# EasyEDA Pro project ProPrj_Avaota A1 八核 AIoT 开发板_2024-05-03.epro, board 点位_BOTTOM (continued)
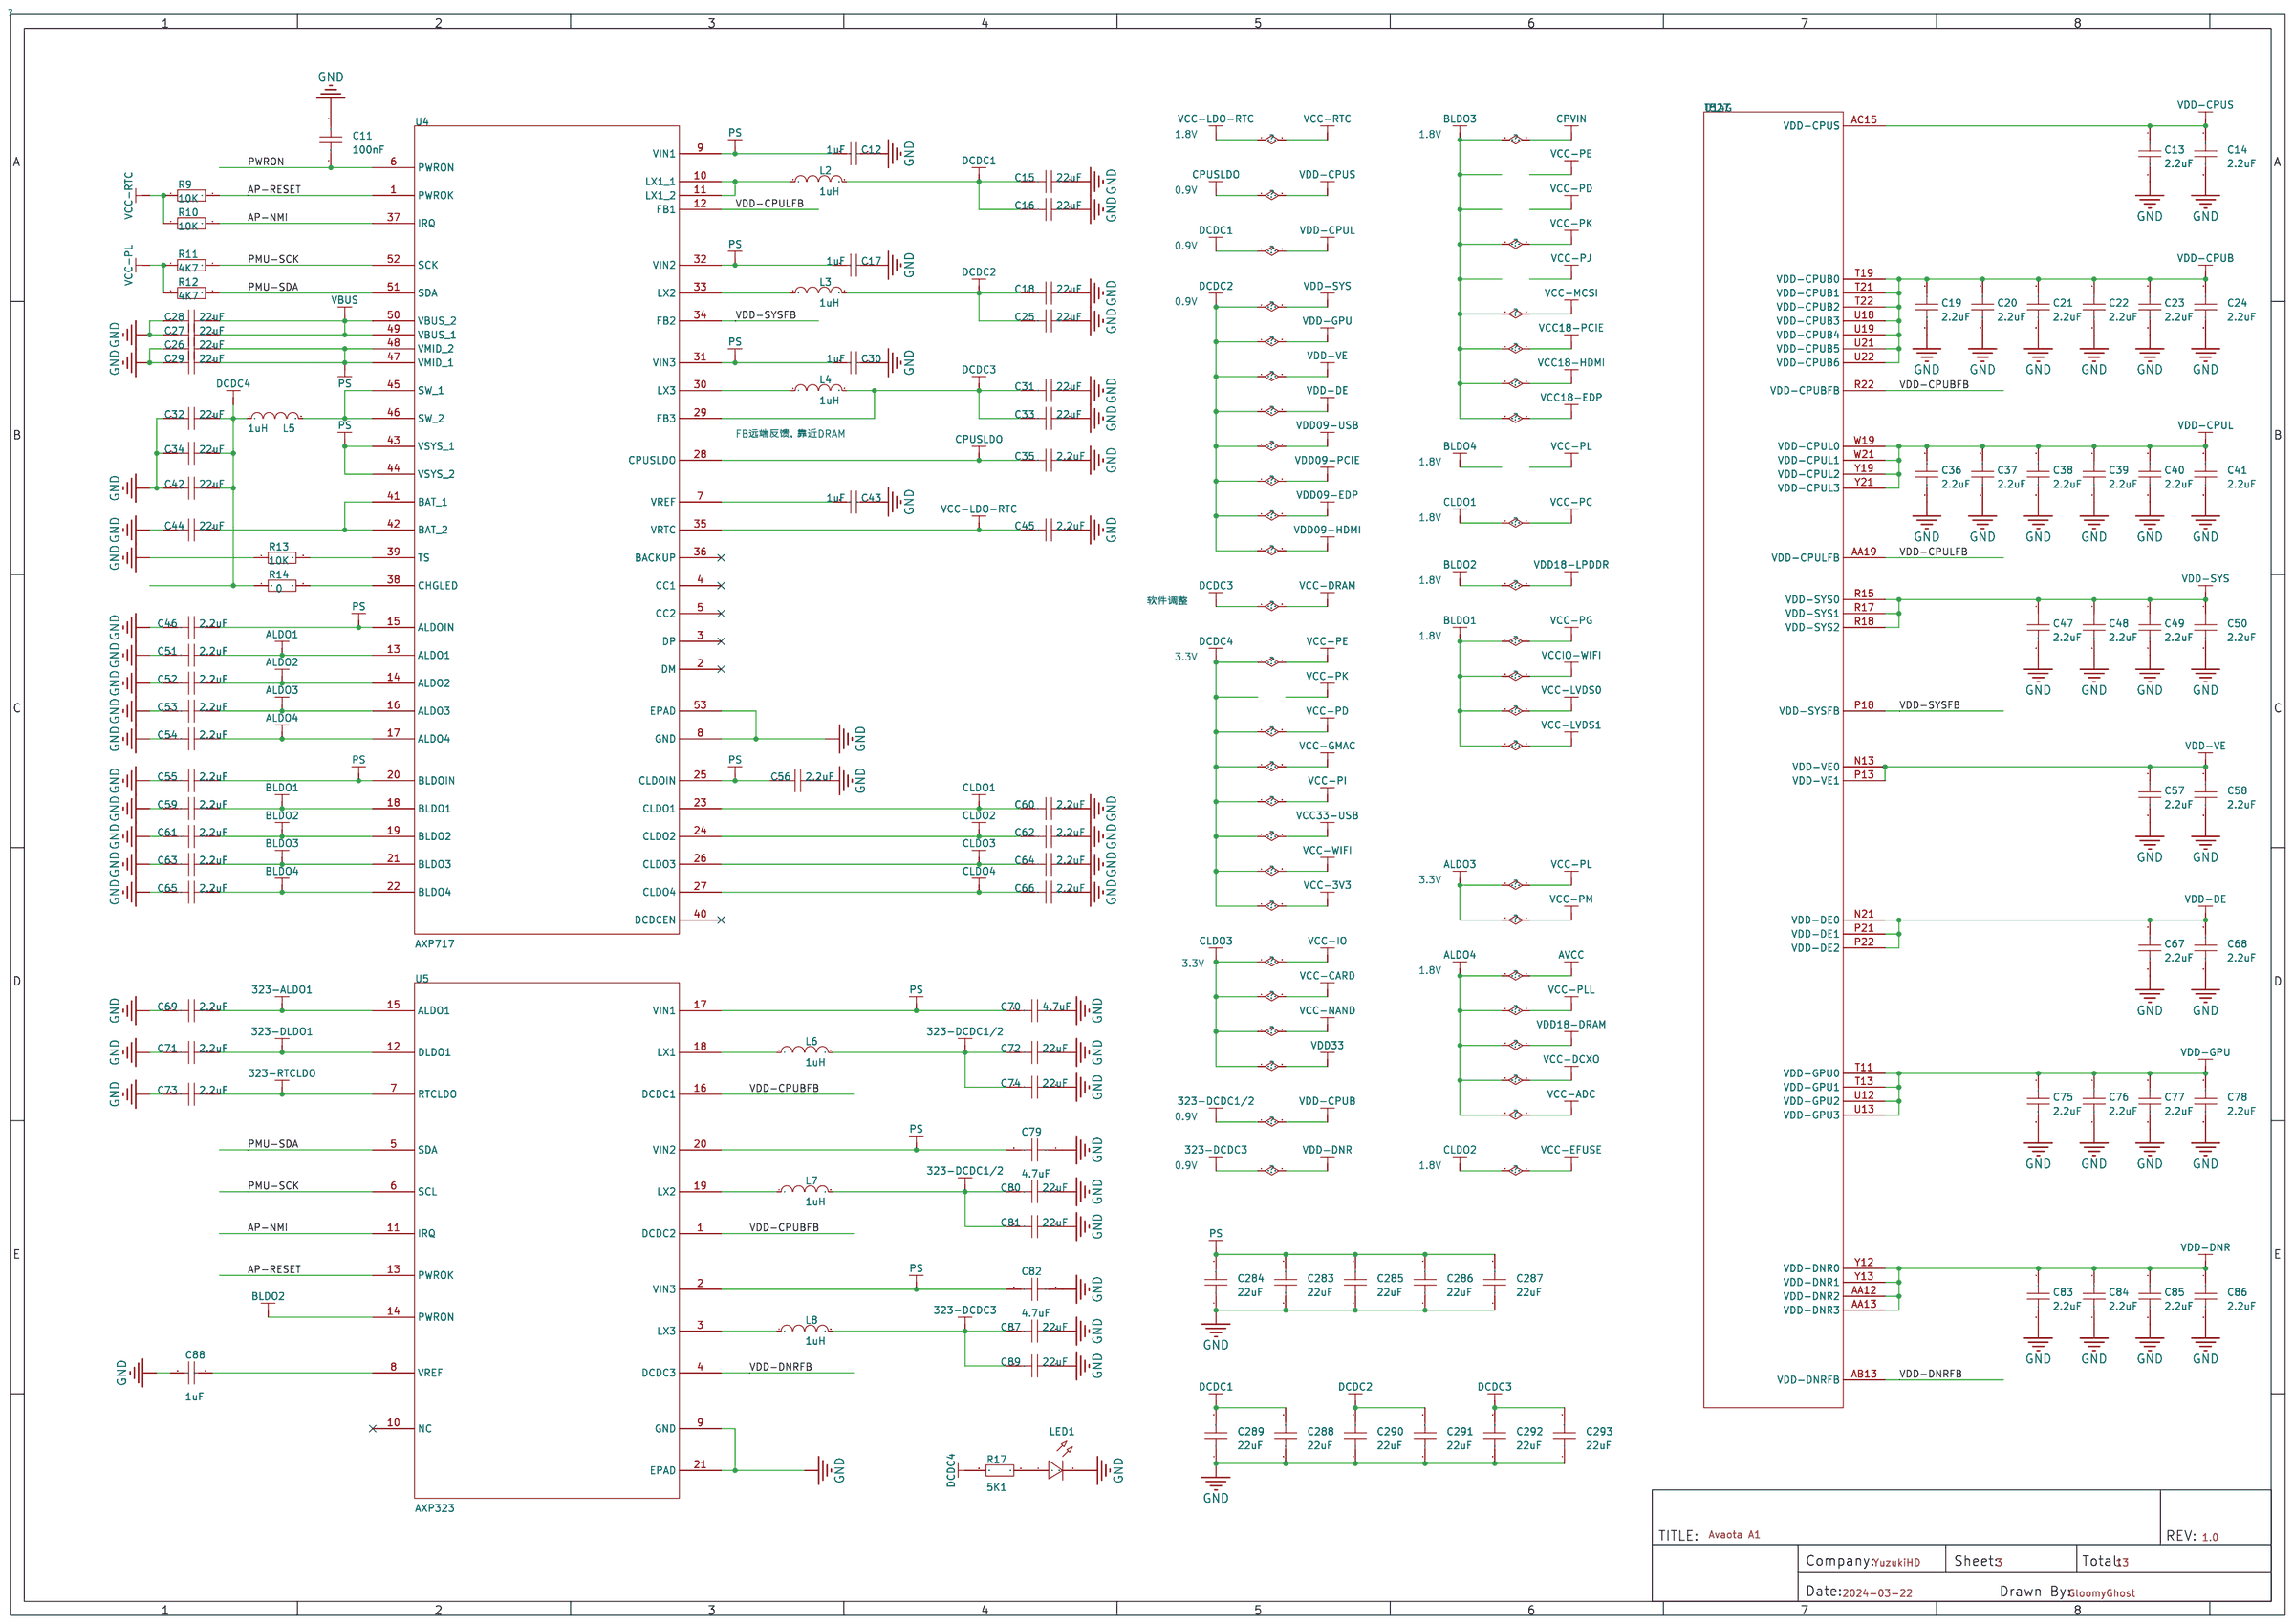
[diagram p0: POWER]
## Routing (per net, layer and track width the routed paths; a pad name or vN(x,y) marks a point on that pad's centre or on a via; arc(x,y) is an arc through that point) (continued)
  Bottom Layer w0.127: C238.1 70.48,67.75 70.3,67.57 70.3,66.88 70.64,66.55 70.64,64.55 68.65,62.56 67.92,62.56 v1(66.12,60.76)
PE0: length 57.3
  Inner5 w0.102: 20.6,73.23 21.89,71.93 21.89,69.82 23.29,68.43 26.11,68.43 27.86,66.68 53.06,66.68 57.71,62.03 59.61,62.03 63.93,57.71 63.93,57.1 65.53,55.5 67.11,55.5 67.29,55.31 67.29,54.6 67.74,54.15 v2(67.94,54.15)
PE1: length 45
  VCC w0.102: v2(72.67,57.2) 72.29,57.58 71.22,57.58 71.12,57.48 67.18,57.48 66.19,58.47 64.8,58.47 61.29,61.98 57.05,61.98 52.5,66.52 37.49,66.52 33.32,70.69 33.3,70.69
PE2: length 52.2
  Inner5 w0.102: 23.14,70.69 25.04,68.78 26.24,68.78 27.99,67.03 53.26,67.03 57.94,62.36 59.77,62.36 64.26,57.86 64.26,57.25 65.68,55.83 67.23,55.83 67.59,55.47 67.59,54.87 67.78,54.68 67.93,54.68 v2(67.95,54.65)
PE3: length 54.4
  Inner5 w0.102: v2(67.95,55.15) 67.95,55.65 67.44,56.16 65.76,56.16 64.59,57.33 64.59,58.12 60.02,62.69 58.14,62.69 53.47,67.36 28.19,67.36 26.39,69.16 25.04,69.16 24.46,69.75 24.46,72.16 24.88,72.58 25.03,72.58 25.68,73.23
PE4: length 51.8
  Inner5 w0.102: 25.68,70.69 25.68,70.46 28.45,67.69 53.64,67.69 57.53,63.81 59.51,63.81 65.71,57.61 70.51,57.61 v2(71.5,58.6)
PE5: length 48.7
  VCC w0.102: 33.3,73.23 33.3,73.15 32.03,71.88 32.03,69.98 35.81,66.19 52.3,66.19 56.85,61.65 61.11,61.65 64.62,58.14 66.01,58.14 67.01,57.15 71.53,57.15 v2(71.58,57.2)
PE6: length 47.3
  VCC w0.102: 30.76,70.69 30.76,70.64 35.53,65.86 52.17,65.86 56.77,61.27 60.96,61.27 64.36,57.86 65.84,57.86 66.88,56.82 71.81,56.82 72.14,57.15 v2(72.14,57.2)
PE7: length 47.4
  VCC w0.102: v2(72.62,58.62) 72.62,58.34 72.11,57.84 71.07,57.84 71.02,57.79 67.36,57.79 66.37,58.78 65,58.78 61.47,62.31 57.2,62.31 52.65,66.85 37.69,66.85 34.62,69.93 34.62,72.03 35.81,73.23 35.84,73.23
PE8: length 41.9
  VCC w0.102: v2(72.06,58.6) 71.55,58.09 67.49,58.09 66.5,59.08 65.2,59.08 61.59,62.69 57.38,62.69 52.81,67.26 38.81,67.26 35.84,70.23 35.84,70.69
PE9: length 53.2
  Inner5 w0.102: 28.22,73.23 28.22,73.18 26.97,71.93 26.97,69.67 28.63,68.02 53.85,68.02 57.63,64.24 59.72,64.24 66.07,57.89 70.23,57.89 v2(70.94,58.6)
PE10: length 35.6
  Inner5 w0.102: v2(70.41,58.6) 69.98,58.17 66.32,58.17 61.52,62.97 61.52,64.16 61.32,64.36 60.22,64.36 59.49,65.1 58.06,65.1 54.81,68.35 43.26,68.35 40.92,70.69
PE11: length 59.3
  Inner5 w0.102: v2(65.95,53.15) 65.91,53.15 65.35,53.7 65.35,54.79 62.59,57.56 61.37,57.56 60.55,58.37 60.55,60.07 59.23,61.39 57.2,61.39 52.58,66.01 27.48,66.01 25.81,67.69 18.52,67.69 15.52,70.69
PE12: length 41.7
  VCC w0.102: v2(69.8,58.62) 69.57,58.39 67.72,58.39 66.67,59.44 65.41,59.44 61.77,63.07 59.72,63.07 58.95,63.83 56.79,63.83 52.96,67.67 38.86,67.67 37.13,69.39 37.13,71.98 38.38,73.23
PE13: length 54.5
  Inner5 w0.102: 20.6,70.69 20.6,70.56 23.09,68.07 25.96,68.07 27.69,66.35 52.78,66.35 57.45,61.67 59.44,61.67 60.86,60.25 60.86,58.57 61.54,57.89 62.69,57.89 65.48,55.09 66.09,55.09 66.42,54.76 66.42,54.31 66.57,54.15 v2(66.95,54.15)
PE14: length 61.2
  Inner5 w0.102: v2(64.95,53.15) 64.57,53.53 64.57,54.08 64.31,54.33 64.31,55.42 62.48,57.25 61.16,57.25 60.25,58.17 60.25,59.89 59.06,61.09 57.01,61.09 52.41,65.68 27.25,65.68 25.63,67.31 16.36,67.31 12.98,70.69
PE15: length 62.6
  Inner5 w0.102: 10.44,70.69 10.44,70.36 13.84,66.95 25.43,66.95 27,65.38 45.03,65.38 49.63,60.78 55.68,60.78 56.29,60.17 57.73,60.17 61.52,56.39 62.86,56.39 63.96,55.3 63.96,54.28 64.31,53.92 64.31,53.34 64.12,53.15 v2(63.95,53.15)
PGAOUT0: length 6
  Bottom Layer w0.076: v2(61.95,52.65) 62.56,53.26
  Bottom Layer w0.152: 62.56,53.26 62.59,53.29 62.59,55.98 62.18,56.39 60.86,56.39 60.71,56.24 R26.1
PGAOUT1: length 4
  Bottom Layer w0.152: R27.1 61.76,55.21 61.44,54.89 v2(61.44,51.65)
PHYRSTB0: length 44.6
  内层2 w0.102: v2(67.94,49.15) 69.32,49.15 70.05,49.89 72.42,49.89 72.8,50.27 74.63,50.27 74.88,50.01 76.45,50.01 79.45,47.02 79.45,29.46 73.58,23.6 73.58,21.64 72.97,21.03 72.01,21.03 72.01,21.03 v2(70.39,21.03)
PHYRSTB1: length 33.4
  内层2 w0.102: v2(89.53,51.23) 89.28,50.98 89.28,28.98 90.07,28.19 90.07,26.7 91.52,25.25 91.52,24.33 90.6,23.42 90.27,23.42 89.99,23.14 89.99,22.66 90.14,22.5 90.14,21.64 89.31,20.8 v2(88.65,20.8)
PMU-SCK: length 48.6
  Bottom Layer w0.102: v1(37.36,56.69) 36.55,56.69 35.86,56.01 14.4,56.01 12.47,54.08 12.47,50.06 11.1,48.69 6.26,48.69 5.65,49.3 5.38,49.3 v2(5.16,49.07) 5.16,48.9 5.82,48.23 5.82,46.05 6.93,44.93 11.94,44.93 v2(12.32,45.31)
PMU-SDA: length 50.2
  Bottom Layer w0.102: v1(36.75,57.07) 36.42,57.07 35.66,56.31 13.51,56.31 12.24,55.04 12.24,50.24 10.97,48.97 6.35,48.97 5.71,49.61 v2(5.13,49.61) 4.8,49.28 4.8,48.92 5.56,48.16 5.56,45.92 6.78,44.7 12.24,44.7 v2(12.85,45.31)
PS: length 11.1
  Bottom Layer w0.102: v2(11.02,50.01) C46.1
  Bottom Layer w0.381: v2(10.95,54) 11.1,53.85 11.1,53.31 ; v2(9.58,49.53) 9.68,49.43 C30.1 ; v2(10.95,52.02) 11.1,52.17 11.1,52.43
  Bottom Layer w0.508: C79.2 C29.1 5.79,52.83 5.82,52.86 v2(6.38,52.86) 6.5,52.98 C26.1 ; C79.2 6.02,51.28 v2(6.38,51.28) ; C79.2 6.13,51.05 v2(6.38,50.81) ; 5.89,52.38 v2(6.38,52.38) ; C286.2 8.79,55.13 v2(8.79,54.15) ; 11.05,51.35 10.95,51.45 v2(10.95,52.02) ; C285.2 9.32,55.28 v2(9.32,54.15)
  vias: v2(8.99,55.22) v2(16.79,45.1) v2(17.65,44.17) v2(18.19,41.81)
PWRON: length 15.4
  内层4 w0.152: v2(8.66,49.5) 9.07,49.1 10.85,49.1 11,48.95 23.24,48.95 v1(23.65,48.54)
RGMII0-CLKIN: length 40.9
  内层2 w0.102: v2(63.35,22.63) 63.52,22.45 71.7,22.45 72.31,23.06 72.31,24 78.51,30.2 78.51,46.51 75.84,49.17 74.14,49.17 v2(74.04,49.28)
RGMII0-MDC: length 35.2
  内层2 w0.102: v2(72.42,21.49) 72.72,21.79 72.72,23.88 78.82,29.97 78.82,46.66 76.05,49.43 74.47,49.43 74.24,49.66 73.2,49.66 v2(72.85,49.3)
RGMII0-MDIO: length 35.9
  内层2 w0.102: v2(72.29,49.3) 72.92,49.94 74.47,49.94 74.7,49.71 76.25,49.71 79.12,46.84 79.12,29.69 73.1,23.67 73.1,21.9 v2(73.18,21.82)
RGMII0-RXCK: length 38.6
  内层2 w0.102: v2(66.19,26.76) 66.42,26.53 66.42,25.2 67.39,24.23 70.51,24.23 77.27,30.99 77.27,45.92 75.16,48.03 71.96,48.03 v2(70.66,49.33)
RGMII0-RXCTL: length 39.7
  内层2 w0.102: v2(67.94,48.15) 68.43,48.64 70.79,48.64 71.75,47.68 75.11,47.68 76.91,45.87 76.91,31.19 70.28,24.56 67.49,24.56 66.75,25.3 v2(66.75,26.76)
RGMII0-RXD0: length 38.9
  内层2 w0.102: v2(67.44,48.15) 67.44,47.93 67.59,47.78 68.1,47.78 68.61,48.29 70.69,48.29 71.6,47.37 74.93,47.37 76.58,45.72 76.58,31.39 70.03,24.84 67.64,24.84 67.11,25.37 67.11,26.39 67.34,26.62 v2(67.34,26.76)
RGMII0-RXD1: length 37.8
  内层2 w0.102: v2(67.96,26.76) 67.46,26.26 67.46,25.53 67.87,25.12 69.75,25.12 76.25,31.62 76.25,45.57 74.78,47.04 71.48,47.04 70.56,47.96 68.76,47.96 68.34,47.54 67.42,47.54 66.94,48.02 v2(66.94,48.15)
RGMII0-RXD2: length 46
  内层4 w0.102: v2(67.94,50.15) 68.06,50.15 70.03,48.18 78.21,48.18 80.57,45.82 80.57,28.8 76.78,25.02 69.77,25.02 68.55,26.24 v2(68.55,26.76)
RGMII0-RXD3: length 45.3
  内层4 w0.102: v2(69.19,26.76) 68.94,26.5 68.94,26.29 69.93,25.3 76.68,25.3 80.29,28.91 80.29,45.64 78.03,47.9 69.9,47.9 68.05,49.76 67.84,49.76 v2(67.44,50.15)
RGMII0-TXCK: length 41.4
  内层2 w0.076: v2(66.42,50.17) 66.78,50.52 68.07,50.52 68.43,50.17 68.94,50.17 69.04,50.27
  内层2 w0.102: v2(76.84,23.93) 76.84,25.17 80.44,28.78 80.44,47.52 76.99,50.98 75.41,50.98 75.16,51.23 72.42,51.23 71.91,50.72 69.49,50.72 69.04,50.27
RGMII0-TXCTL: length 40.4
  内层2 w0.102: v2(76.2,23.9) 76.45,24.16 76.45,25.37 80.11,29.03 80.11,47.35 76.81,50.65 75.21,50.65 74.96,50.9 72.52,50.9 72.03,50.42 69.7,50.42 69.01,49.73 67.36,49.73 v2(66.94,50.15)
RGMII0-TXD0: length 39.8
  内层2 w0.102: v2(67.44,49.15) 67.79,49.5 69.24,49.5 69.9,50.17 72.19,50.17 72.62,50.6 74.78,50.6 75.03,50.34 76.63,50.34 79.78,47.19 79.78,29.24 76.1,25.55 76.1,24.38 75.62,23.9 v2(75.62,23.5)
RGMII0-TXD1: length 33.8
  内层2 w0.102: v2(70.16,23.11) 70.41,22.86 71.65,22.86 71.96,23.17 71.96,24.13 78.23,30.4 78.23,46.3 75.64,48.9 73.86,48.9 v2(73.46,49.3)
RGMII0-TXD2: length 33.2
  内层2 w0.102: v2(71.2,49.33) 72.19,48.34 75.29,48.34 77.6,46.03 77.6,30.79 71.2,24.38 71.2,23.57 v2(70.97,23.34)
RGMII0-TXD3: length 32.9
  内层2 w0.102: v2(71.55,23.34) 71.55,24.23 77.93,30.61 77.93,46.13 75.44,48.62 72.44,48.62 v2(71.73,49.33)
RGMII1-CLKIN: length 33.4
  内层2 w0.102: v2(83.16,53.72) 83.16,52.12 83.74,51.54 83.74,48.34 84.56,47.52 84.56,27.89 83.87,27.2 83.87,26.44 84.25,26.06 84.25,25.21 v2(81.53,22.49)
RGMII1-MDC: length 31.5
  内层2 w0.102: v2(90.45,22.94) 90.7,22.94 91.9,24.13 91.9,25.43 90.37,26.95 90.37,28.35 89.61,29.11 89.61,50.75 89.92,51.05 89.92,51.38 89.66,51.64 89.41,51.64 89.26,51.49 89.2,51.49 v2(88.95,51.23)
RGMII1-MDIO: length 30.8
  内层2 w0.102: v2(88.37,51.23) 88.9,50.7 88.9,28.91 89.66,28.14 89.66,26.57 91.11,25.12 91.11,24.49 90.37,23.75 90.04,23.75 89.71,23.42 89.71,22.86 v2(89.33,22.48)
RGMII1-RXCK: length 57.8
  内层2 w0.102: v2(84.28,26.61) 84.28,27.03 84.88,27.63 84.88,47.7 84.1,48.49 84.1,51.74 83.57,52.27 83.57,53.87 82.98,54.46 82.98,54.97 83.36,55.35 83.74,55.35 84.33,55.93 84.33,57.63 82.17,59.79 68.53,59.79 67.56,58.83 67.56,53.87 67.26,53.57 66.7,53.57 66.12,54.15 v2(65.95,54.15)
RGMII1-RXCTL: length 26.5
  内层2 w0.102: v2(84.02,52.48) 84.48,52.02 84.48,48.64 85.19,47.93 85.19,27.46 84.81,27.08 v2(84.81,26.61)
RGMII1-RXD0: length 29
  内层2 w0.102: v2(85.37,26.61) 85.37,27.15 85.5,27.28 85.5,48.18 84.81,48.87 84.81,52.3 83.92,53.19 83.92,54.13 83.41,54.64 v2(83.39,54.64)
RGMII1-RXD1: length 28.9
  内层2 w0.102: v2(85.95,26.61) 85.95,27.18 85.83,27.31 85.83,48.41 85.14,49.1 85.14,52.5 84.25,53.39 84.25,54.36 v2(83.92,54.69)
RGMII1-RXD2: length 57.7
  内层2 w0.102: v2(65.95,54.65) 66.8,53.8 67.11,53.8 67.31,54 67.31,55.7 67.21,55.8 67.21,59.03 68.33,60.15 82.32,60.15 84.66,57.81 84.66,53.49 85.47,52.68 85.47,49.25 86.13,48.59 86.13,27.48 86.51,27.1 v2(86.51,26.61)
RGMII1-RXD3: length 56.8
  内层2 w0.102: v2(66.95,54.65) 66.57,55.03 66.57,55.32 66.9,55.65 66.9,59.26 68.17,60.53 82.47,60.53 85.04,57.96 85.04,53.67 85.85,52.86 85.85,49.45 86.46,48.84 86.46,27.66 87.07,27.05 v2(87.07,26.61)
RGMII1-TXCK: length 28.7
  内层2 w0.102: v2(87.76,25.1) 87.5,25.35 87.5,27.23 86.82,27.91 86.82,49 86.23,49.58 86.23,53.14 v2(86.18,53.19)
RGMII1-TXCTL: length 29.8
  内层2 w0.102: v2(86.51,54.15) 86.51,53.52 86.61,53.42 86.61,49.78 87.15,49.25 87.15,28.07 87.83,27.38 87.83,25.58 v2(88.32,25.1)
RGMII1-TXD0: length 32.1
  内层2 w0.102: v2(85.42,55.3) 85.72,54.99 86.56,54.99 86.97,54.58 86.97,49.96 87.5,49.43 87.5,28.22 88.16,27.56 88.16,25.81 v2(88.87,25.1)
RGMII1-TXD1: length 32
  内层2 w0.102: v2(89.46,25.1) 88.52,26.04 88.52,27.71 87.86,28.37 87.86,49.66 87.33,50.19 87.33,54.71 86.77,55.27 86.39,55.27 v2(86.13,55.52)
RGMII1-TXD2: length 61.6
  内层2 w0.102: v2(64.95,54.15) 65.33,54.52 65.33,56.85 65.81,57.33 65.81,58.73 68.07,60.99 82.6,60.99 86.54,57.05 86.54,56.03 87.68,54.89 87.68,50.39 88.19,49.89 88.19,28.58 88.9,27.86 88.9,26.21 v2(90.02,25.1)
RGMII1-TXD3: length 65
  内层2 w0.102: v2(64.95,54.65) 64.95,56.92 65.46,57.43 65.46,58.85 67.92,61.32 82.8,61.32 86.89,57.23 86.89,56.24 88.01,55.12 88.01,50.7 88.54,50.17 88.54,28.75 89.31,27.99 89.31,26.42 90.75,24.97 90.75,24.66 90.22,24.13 89.89,24.13 89.31,23.55 v2(89.31,23.14)
SAA0: length 11.2
  Inner5 w0.115: v3(44.78,43.74) 45.28,43.74 46.2,42.82 46.48,42.82 47.27,42.04 51.43,42.04 52.42,41.05 54.79,41.05 v3(54.87,41.12)
SAA1: length 12
  Inner5 w0.076: 54.18,41.33 54.51,41.33 54.61,41.35 v3(54.96,41.66)
  Inner5 w0.115: v3(44.4,44.48) 44.41,44.48 44.56,44.32 45.22,44.32 46.35,43.19 46.63,43.19 47.38,42.44 51.42,42.44 51.67,42.19 52.3,42.19 53.17,41.33 54.18,41.33 ; v3(54.96,41.66) 54.92,41.66
SAA2: length 22.5
  Inner5 w0.076: v3(55.98,42.14) 55.93,42.14 55.6,41.81 55.29,41.81 55.09,42.01 54.13,42.01 54.05,41.93
  Inner5 w0.115: 54.05,41.93 53.87,41.93 52.91,42.9 52.35,42.9 52.27,42.82 52,42.82 51.61,43.21 47.66,43.21 46.94,43.93 46.66,43.93 45.54,45.05 44.88,45.05 44.66,45.26 44.08,45.26 43.56,44.74 40.68,44.74 40.51,44.91 39.13,44.91 39.01,45.02 39.01,45.24 38.63,45.62 38.12,45.62 37.62,45.11 36.24,45.11 v3(36.17,45.18)
SAA3: length 25.3
  内层2 w0.076: 53.87,42.82 54.07,43.02 55.7,43.02 55.98,42.75 v3(55.98,42.67)
  内层2 w0.115: 53.87,42.82 53.21,42.16 52.5,42.16 52.31,42.35 44.18,42.35 43.97,42.57 43.58,42.57 42.7,43.46 42.39,43.46 41.48,44.37 40.76,44.37 40.56,44.17 39.16,44.17 38.63,44.7 38.4,44.7 37.97,45.14 37.97,46.28 37.87,46.38 36.85,46.38 36.73,46.25 36.73,45.11 36.4,44.78 35.72,44.78 v3(35.33,45.17)
SAA4: length 23.8
  Inner5 w0.076: v3(55.43,42.15) 55.4,42.19 53.99,42.19
  Inner5 w0.115: v3(34.59,45.26) 34.59,45.72 35.1,46.23 35.89,46.23 36.04,46.38 38.76,46.38 38.89,46.25 38.89,46.13 39.19,45.82 39.57,45.82 40.13,45.26 41.68,45.26 41.83,45.11 43.41,45.11 43.93,45.63 44.82,45.63 45.03,45.42 45.69,45.41 46.81,44.3 47.09,44.3 47.8,43.59 52.25,43.59 52.6,43.23 52.94,43.23 53.99,42.19
SAA5: length 27.7
  Inner5 w0.115: v3(34.72,46.51) 35.23,47.02 35.23,47.24 37.16,49.17 38.89,49.17 39.16,49.45 39.67,49.45 39.88,49.25 40.41,49.25 40.59,49.43 41.1,49.43 41.35,49.18 41.35,49 41.68,48.67 42.67,48.67 43.47,47.87 45.39,47.87 46.97,46.29 47.6,46.29 48.02,45.87 52.09,45.87 52.47,45.49 52.7,45.49 54.05,44.14 54.05,43.56 54.3,43.31 55.88,43.31 56.34,42.85 56.34,41.96 56,41.63 v3(55.93,41.63)
SAB0: length 22.1
  内层2 w0.076: v3(55.47,43.68) 55.47,43.56 55.12,43.21 54,43.21
  内层2 w0.115: 54,43.21 53.59,43.21 53.47,43.08 52.83,43.08 52.42,42.67 51.67,42.67 51.55,42.79 51.55,42.92 51.44,43.04 51.29,43.04 51.17,42.92 51.17,42.79 51.06,42.67 50.91,42.67 50.79,42.79 50.79,42.92 50.68,43.04 50.53,43.04 50.41,42.92 50.41,42.79 50.3,42.67 50.14,42.67 50.03,42.79 50.03,42.92 49.92,43.04 49.76,43.04 49.65,42.92 49.65,42.79 49.53,42.67 49.38,42.67 49.27,42.79 49.27,42.92 49.15,43.04 49,43.04 48.89,42.92 48.89,42.79 48.77,42.67 48.09,42.67 47.97,42.79 47.97,43.27 47.86,43.38 47.71,43.38 47.59,43.27 47.59,42.79 47.48,42.67 47.33,42.67 47.21,42.79 47.21,43.27 47.1,43.38 46.95,43.38 46.83,43.27 46.83,42.79 46.72,42.67 46.57,42.67 46.25,42.99 46.25,43.6 45.22,44.63 44.93,44.63 42.19,47.37 42.19,48.72 v3(41.81,49.1)
SAB1: length 19.4
  内层2 w0.115: v3(56.01,43.68) 55.59,44.09 52.52,44.09 52.07,44.55 51.14,44.55 51.03,44.44 51.03,44.1 50.91,43.98 50.76,43.98 50.64,44.1 50.64,44.44 50.53,44.55 50.38,44.55 50.26,44.44 50.26,44.1 50.15,43.98 50,43.98 49.88,44.1 49.88,44.44 49.77,44.55 49.62,44.55 49.5,44.44 49.5,44.1 49.39,43.98 49.23,43.98 49.12,44.1 49.12,44.44 49.01,44.55 46.96,44.55 45.78,45.73 45.39,45.73 44.33,46.79 44.33,46.97 44.88,47.52 44.88,47.7 44.65,47.93 44.28,47.93 44.12,47.77 44.12,47.39 44,47.28 43.84,47.28 43.71,47.41 v3(43.71,48.29)
SAB2: length 22.2
  内层2 w0.115: v3(54.43,43.71) 54.36,43.79 52.45,43.79 52.26,43.98 51.47,43.98 51.2,43.71 49.05,43.71 48.66,44.09 46.9,44.09 45.63,45.36 45.24,45.36 43.33,47.27 43.33,48.68 42.15,49.86 40.46,49.86 40.36,49.96 39.24,49.96 38.71,49.43 36.54,49.43 v3(36.19,49.78)
SAB3: length 21.7
  内层2 w0.076: 53.44,43.54 53.95,43.54 54.1,43.38 54.67,43.38 v3(54.96,43.68)
  内层2 w0.115: v3(37.79,48.44) 38.4,49.05 38.78,49.05 39.22,49.48 39.65,49.48 40,49.12 40.33,49.12 40.69,49.48 41.96,49.48 42.95,48.49 42.95,47.13 45.08,45 45.38,45 46.66,43.71 48.54,43.71 48.92,43.33 51.46,43.33 51.74,43.61 52.25,43.61 52.42,43.43 53.34,43.43 53.44,43.54
SAB4: length 22.5
  Inner5 w0.076: 54.07,42.44 54.15,42.37 55.14,42.37 v3(55.47,42.7)
  Inner5 w0.115: 54.07,42.44 54.07,42.47 53.01,43.54 52.73,43.54 52.3,43.97 47.94,43.97 47.24,44.67 46.96,44.67 45.84,45.78 45.18,45.78 44.97,46 43.13,46 42.74,45.61 40.75,45.61 40.59,45.77 40.59,46.05 39.88,46.76 36.01,46.76 v3(35.63,47.14)
SAB5: length 24.5
  Inner5 w0.115: v3(34.34,46.96) 34.19,46.81 34.19,45.08 34.41,44.86 34.85,44.86 35,44.7 36.17,44.7 36.55,44.32 37.89,44.32 38.28,44.7 38.63,44.7 39.17,44.16 40.5,44.16 40.66,44.32 43.69,44.32 44.25,44.88 44.52,44.88 44.72,44.68 45.39,44.68 46.5,43.56 46.79,43.56 47.52,42.82 51.56,42.82 51.9,42.48 52.35,42.48 53.17,41.66 v3(54.43,41.66)
SCKE0-A: length 11.1
  内层2 w0.115: v3(38.5,46) 38.5,46.63 39.27,47.4 41.43,47.4 42.16,46.66 42.16,45.54 42.72,44.98 43.38,44.98 44.25,44.11 44.92,44.11 45.75,43.28 v3(45.75,42.76)
SCKE0-B: length 7.1
  Inner5 w0.115: v3(45.11,47.12) 43.18,47.12 43.03,47.27 41.04,47.27 40.41,47.9 39.19,47.9 39.06,48.03 39.06,48.27 39.23,48.44 v3(39.39,48.44)
SCKE1-A: length 9.2
  内层2 w0.115: v3(44.09,42.98) 44.09,42.99 43.7,42.99 43.23,43.46 43.23,44.02 43,44.25 42.16,44.25 41.43,44.98 40.92,44.98 40.61,45.29 40.61,46.18 40.41,46.38 40.03,46.38 39.77,46.13 39.77,45.11 39.6,44.93 39.04,44.93 38.76,45.21 v3(38.5,45.21)
SCKE1-B: length 10.4
  Inner5 w0.115: v3(38.63,48.41) 38.3,48.41 37.82,47.93 37.82,47.62 37.92,47.52 38.12,47.52 38.23,47.64 38.23,47.92 38.35,48.03 38.58,48.03 38.69,47.92 38.69,47.64 38.8,47.52 40.23,47.52 40.87,46.89 42.88,46.89 43.04,46.74 45.34,46.74 45.55,46.52 v3(45.7,46.52)
SCS0-A: length 10.5
  内层2 w0.115: v3(45.24,43.23) 45.11,43.36 43.85,43.36 43.6,43.61 43.6,44.17 43.15,44.61 42.43,44.61 41.37,45.67 41.37,46.9 41.26,47.02 39.39,47.02 39.01,46.63 39.01,45.67 v3(39.39,45.29)
SCS0-B: length 22.4
  Inner5 w0.115: v3(39.39,49.1) 39.11,48.82 37.62,48.82 37.41,48.62 37.41,47.35 37.62,47.14 40.03,47.14 40.7,46.47 42.79,46.47 42.88,46.37 45.12,46.37 45.34,46.15 46,46.15 47.11,45.03 47.4,45.03 48.12,44.31 52.36,44.31 52.78,43.89 53.03,43.89 54.23,42.7 v3(54.41,42.7)
SCS1-A: length 6.4
  Inner5 w0.115: v3(44.63,42.75) 44.74,42.75 44.85,42.86 44.85,43.24 44.74,43.36 43.9,43.36 43.79,43.47 43.79,43.85 43.67,43.97 43.44,43.97 43.33,43.85 43.33,43.36 43.22,43.24 42.94,43.24 42.72,43.46 42.56,43.46 42.44,43.57 42.44,43.84 42.36,43.92 42.11,43.92 42,43.8 42,43.7 41.88,43.59 41.66,43.59 41.54,43.7 41.54,43.8 41.43,43.92 v3(41.02,43.92)
SCS1-B: length 21.6
  Inner5 w0.115: v3(40.92,49.07) 40.76,49.07 40.61,48.92 40.61,48.21 41.07,47.75 43.06,47.75 43.32,47.5 45.24,47.5 46.81,45.92 47.48,45.92 47.64,45.77 47.64,45.32 48.3,44.65 48.42,44.65 48.53,44.77 48.53,44.94 48.65,45.06 48.88,45.06 48.99,44.94 48.99,44.77 49.1,44.65 49.33,44.65 49.45,44.77 49.45,44.98 49.56,45.09 49.79,45.09 49.91,44.98 49.91,44.77 50.02,44.65 50.25,44.65 50.36,44.77 50.36,44.94 50.48,45.06 50.7,45.06 50.82,44.94 50.82,44.77 50.93,44.65 51.16,44.65 51.28,44.77 51.28,44.94 51.39,45.06 51.62,45.06 51.73,44.94 51.73,44.77 51.85,44.65 52,44.65 52.12,44.77 52.12,44.97 52.24,45.09 52.4,45.09 52.53,44.97 52.53,44.6 52.73,44.4 53.16,44.4 53.29,44.27 53.29,44.14 53.39,44.04 53.61,44.04 53.72,43.93 53.72,43.59 54.25,43.05 55.01,43.05 55.12,42.95 55.12,42.79 55.02,42.7 v3(54.94,42.7)
SDC0-CLK: length 13.3
  Bottom Layer w0.102: SIM1.5 98.54,59.91 97.84,59.21 97.84,58.8 96.37,57.33 96.37,56.36 95.58,55.58 95.58,52.03 D19.2 94.77,50.3 v2(94.77,48.82)
SDC0-CMD: length 10.4
  Bottom Layer w0.102: v2(96.6,48.77) 96.6,50.3 D21.2 96.65,51.27 96.65,54.99 97.36,55.7 97.36,56.49 98.58,57.71 SIM1.3
SDC0-D0: length 15.9
  Bottom Layer w0.102: v2(93.83,48.82) 93.83,50.29 D18.1 95.1,52.51 95.1,55.78 95.88,56.57 95.88,57.51 97.18,58.8 97.18,60.71 98.59,62.11 SIM1.7
SDC0-D1: length 17.4
  Bottom Layer w0.102: SIM1.8 98.52,63.21 97.76,62.46 97.76,62 96.7,60.93 96.7,58.93 95.48,57.71 95.48,56.82 94.61,55.96 94.61,52.97 D17.2 92.86,50.3 v2(92.86,48.82)
SDC0-D2: length 7.9
  Bottom Layer w0.102: v2(98.48,48.82) 98.48,50.25 D23.2 97.49,51.24 97.49,54.69 98.31,55.51 SIM1.1
SDC0-D3: length 8.9
  Bottom Layer w0.102: SIM1.2 98.74,56.54 98.45,56.54 97.74,55.83 97.74,55.52 97.08,54.86 D22.1 97.51,50.33 v2(97.51,48.82)
SDC0-DET: length 9.2
  Bottom Layer w0.102: v2(73.81,46.13) 72.01,46.13 71.17,46.96 70.79,46.96 70.69,46.86 68.26,46.86 v2(67.94,47.18)
  Bottom Layer w0.127: v1(91.97,48.51) 91.82,48.67 91.01,48.67 90.7,48.97 90.7,50.33
SDC1-CMD: length 1.6
  Bottom Layer w0.102: v2(21.01,53.8) 22.28,53.8 v2(22.53,53.54)
SDC2-CLK: length 5.1
  Bottom Layer w0.102: v2(37.68,33.64) 37.31,34.01 37.31,34.29 37.59,34.57 38.05,34.57 39.97,36.49 39.97,36.64 39.85,36.75 39.73,36.75 v2(39.52,36.55)
SDC2-CMD: length 5.2
  Bottom Layer w0.102: v2(41.55,36.5) 41.15,36.5 41.15,36.47 40.74,36.07 40.51,36.07 38.86,34.42 38.86,34.22 38.48,33.83 38.18,33.83 37.87,34.14 v2(37.68,34.14)
SDC2-DS: length 26.9
  内层4 w0.127: v2(39.55,34.34) 56.29,34.34 60.81,38.86 v2(60.81,42.64)
SDC2-RST: length 3.3
  Bottom Layer w0.102: v2(38.41,34.24) 38.41,34.47 40.44,36.5 v2(40.59,36.5)
SDQ0: length 20.8
  内层2 w0.115: v3(57.02,42.7) 56.56,42.25 56.56,40.79 56.2,40.43 54.09,40.43 53.83,40.68 51.53,40.68 51.12,41.08 42.86,41.08 42.19,41.76 42.19,42.14 41.96,42.37 41.63,42.37 41.04,42.95 39.7,42.95 39.42,43.23 v3(39.37,43.23)
SDQ1: length 20.4
  内层2 w0.076: 55.88,40.69 55.8,40.61 54.33,40.61 54.25,40.69
  内层2 w0.115: v3(57.05,43.21) 57.03,43.21 56.34,42.52 56.34,40.89 56.13,40.69 55.88,40.69 ; 54.25,40.69 53.94,41.01 51.67,41.01 51.18,41.5 43.63,41.5 43.41,41.73 43.41,42.16 42.89,42.68 42.23,42.68 42.18,42.74 41.77,42.74 41.17,43.33 40.7,43.33 v3(40.22,43.81)
SDQ2: length 13.4
  内层2 w0.076: v3(55.98,41.12) 55.65,40.79 54.58,40.79 54.53,40.84
  内层2 w0.115: 54.53,40.84 54,41.38 53.69,41.38 53.57,41.49 53.57,41.69 53.46,41.81 53.23,41.81 53.12,41.69 53.12,41.49 53,41.38 51.94,41.38 51.38,41.94 43.84,41.94 v3(43.81,41.96)
SDQ3: length 8.8
  内层2 w0.115: v3(53.92,39.01) 53.55,38.64 45.81,38.64 v3(45.44,39.01)
SDQ4: length 15.1
  内层2 w0.115: v3(57.94,41.68) 57.83,41.68 57.43,41.27 57.43,40.69 56.69,39.95 53.57,39.95 53.49,40.03 50.7,40.03 50.49,40.23 44.1,40.23 v3(44.04,40.29)
SDQ5: length 18.7
  内层2 w0.115: v3(57.14,39) 57.14,38.95 55.99,37.8 43.2,37.8 40.42,40.58 40.22,40.58 v3(40.17,40.62)
SDQ6: length 14.6
  内层2 w0.115: v3(43.36,40.29) 43.73,40.67 50.95,40.67 51.28,40.33 53.77,40.33 53.92,40.18 56.41,40.18 56.97,40.74 v3(56.97,41.1)
SDQ7: length 21.7
  内层2 w0.115: v3(39.44,41.3) 39.77,40.97 39.77,40.28 39.5,40 39.5,39.67 41.79,37.38 56.18,37.38 57.65,38.85 v3(57.65,39)
SDQ8: length 25.4
  Inner5 w0.115: v3(37.77,42.87) 38.22,43.33 38.68,43.33 39.14,42.87 39.77,42.87 39.85,42.95 40.63,42.95 40.74,43.07 40.74,43.34 40.85,43.46 41.08,43.46 41.2,43.34 41.2,42.93 41.68,42.44 42.19,42.44 42.36,42.62 42.98,42.62 43.09,42.51 43.09,42.43 43.21,42.32 43.44,42.32 43.55,42.43 43.55,42.51 43.67,42.62 43.91,42.62 44.22,42.32 46.25,42.32 46.97,41.6 51.51,41.6 52.35,40.76 56.38,40.76 56.51,40.89 56.51,41.76 56.82,42.06 58.11,42.06 58.34,42.29 58.34,42.77 58.46,42.88 v3(58.85,42.88)
SDQ9: length 23.8
  Inner5 w0.115: v3(58.82,42.36) 58.82,42.21 58.29,41.68 58.29,40.92 57.68,40.31 51.92,40.31 51.46,40.77 46.78,40.77 46.14,41.41 45.98,41.41 45.74,41.17 45.62,41.17 45.49,41.3 45.49,41.44 45.38,41.55 44.47,41.55 44.06,41.15 42.95,41.15 42.47,40.67 41.92,40.67 41.81,40.78 41.81,40.92 40.99,41.73 40.16,41.73 39.62,42.27 38.67,42.27 38.56,42.15 v3(38.56,41.94)
SDQ10: length 24
  Inner5 w0.115: v3(37.87,40.56) 37.87,40.8 37.98,40.92 39.65,40.92 39.7,40.97 40.59,40.97 40.64,40.92 41.25,40.92 41.43,40.74 41.43,40.4 41.54,40.28 42.68,40.28 43.12,40.73 44.58,40.73 44.69,40.84 44.69,41.06 44.81,41.17 45.03,41.17 45.15,41.06 45.15,40.84 45.26,40.73 46.32,40.73 46.7,40.35 51.29,40.35 51.56,40.08 57.99,40.08 58.52,40.61 58.52,41.33 58.83,41.64 v3(58.9,41.64)
SDQ11: length 22.4
  Inner5 w0.115: v3(58.9,41.1) 58.9,40.61 58.14,39.85 51.21,39.85 51.14,39.93 46.35,39.93 46.25,40.03 46.25,40.2 46.14,40.31 45.62,40.31 45.51,40.21 45.08,40.21 44.91,40.38 44.59,40.38 44.47,40.27 44.47,40.03 44.37,39.93 41.02,39.93 40.74,40.21 39.7,40.21 39.45,39.96 39.29,39.96 38.92,40.32 38.92,40.45 38.81,40.56 v3(38.53,40.56)
SDQ12: length 29.9
  Inner5 w0.115: v3(33.3,39.78) 35.7,37.38 59.09,37.38 59.84,38.12 59.84,38.38 60.22,38.76 60.22,39.12 59.76,39.57 v3(59.5,39.57)
SDQ13: length 27.4
  Inner5 w0.115: v3(34.19,39.78) 34.19,39.4 35.79,37.79 59.1,37.79 59.54,38.23 59.54,38.46 59.83,38.75 v3(59.83,38.94)
SDQ14: length 31.5
  Inner5 w0.115: v3(59.9,42.65) 59.54,42.29 59.54,40.31 58.62,39.4 52.5,39.4 52.19,39.09 45.9,39.09 45.59,39.4 45.29,39.4 44.98,39.09 37.89,39.09 36.19,40.79 36.19,42.29 35.48,43.01 34.93,43.01 34.85,42.93 34.14,42.93 33.88,43.18
  vias: v3(33.88,43.18)
SDQ15: length 30.8
  Inner5 w0.115: v3(59.94,43.18) 59.84,43.18 59.26,42.6 59.26,40.46 58.42,39.62 52.19,39.62 52.08,39.51 46.07,39.51 45.76,39.81 45.11,39.81 44.8,39.5 38.02,39.5 36.6,40.92 36.6,42.34 35.66,43.28 v3(34.62,43.28)
SDQ16: length 6.4
  内层2 w0.115: v3(43.38,50.22) 43.46,50.22 46.04,47.64 46.04,46.71 47.27,45.48 v3(47.27,45.47)
SDQ17: length 7.9
  内层2 w0.115: v3(43.33,51.36) 43.33,50.94 46.45,47.81 46.45,46.89 47.88,45.47 v3(48,45.47)
SDQ18: length 23.1
  内层2 w0.115: v3(56.01,44.68) 56.01,44.83 55.54,45.3 54.29,45.3 53.62,45.97 53.62,46.35 51.84,48.13 51.46,48.13 46.2,53.39 39.39,53.39 39.14,53.14 39.14,51.34 v3(39.4,51.08)
SDQ19: length 11.2
  内层2 w0.115: v3(54.96,44.68) 54.96,44.78 54.68,45.06 53.92,45.06 53.49,45.49 53.36,45.49 50.54,48.31 50.2,48.31 46.73,51.78 v3(46.73,51.79)
SDQ20: length 19
  内层2 w0.115: v3(39.5,52.98) 39.52,53.01 45.9,53.01 46.31,52.59 46.31,51.61 50.01,47.92 50.34,47.92 53.02,45.24 53.36,45.24 53.92,44.68 v3(54.43,44.68)
SDQ21: length 8.9
  内层2 w0.115: v3(51.97,45.47) 51.97,45.64 50.11,47.5 49.83,47.5 45.84,51.48 v3(45.84,51.66)
